# EasyEDA Pro project SMOL_ICM_NIKKI.eprj, schematic smolBrain V3.0
Board Name: smolBrainV3; Create Date: 2025-01-24; Page Name: Smol Slimes NRF by Nikki; Project Name: SMOL_ICM_NIKKI; Schematic Name: smolBrain V3.0; Update Date: 2026-02-03; Company: Des. by --nikki--; Page Size: A4; Version: V3.0
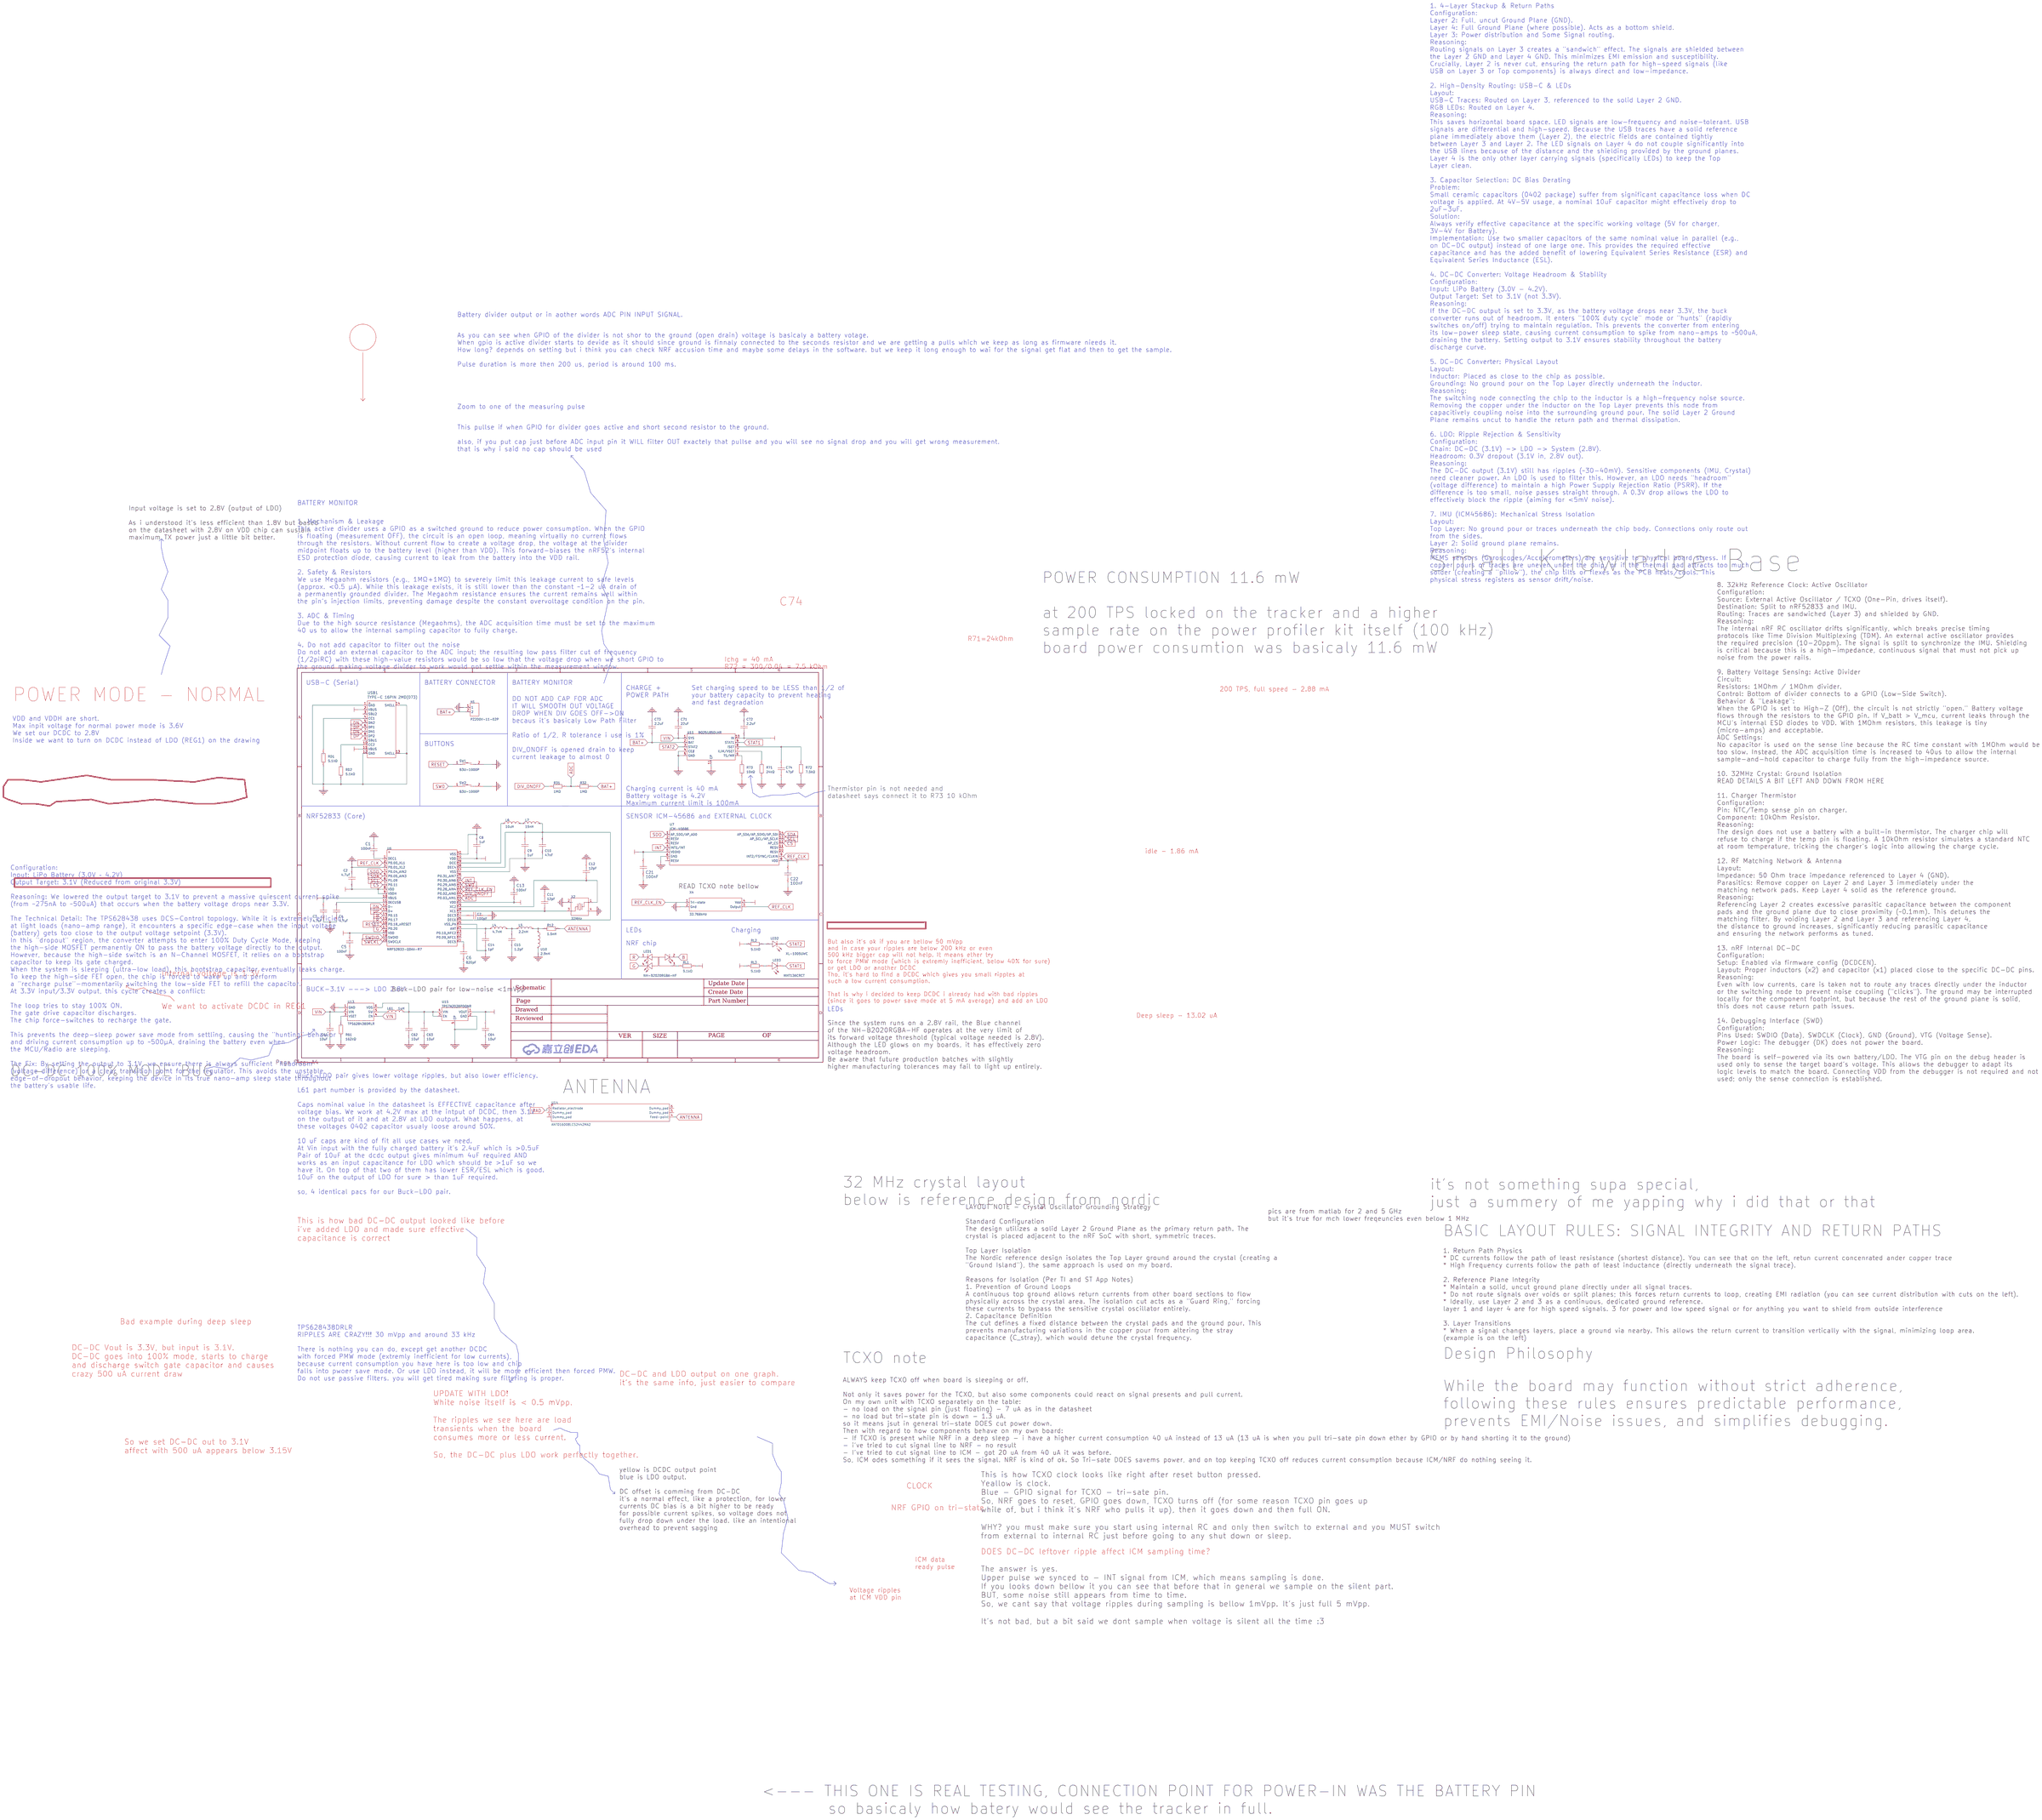
[diagram p0: schematic sheet]

## Parts
C1  100nF  [R0201]
C2  4.7uF  [C0603]
C3  4.7uF  [C0603]
C4  4.7uF  [C0402 small]
C5  100nF  [R0201]
C6  820pF  [R0201]
C7  100pF  [R0201]
C8  1uF  [C0402 small]
C9  1uF  [C0402 small]
C10  47nF  [R0201]
C11  12pF  [R0201]
C12  12pF  [R0201]
C13  100nF  [R0201]
C14  1pF  [R0201]
C15  1.2pF  [R0201]
C21  100nF  [C0201]
C22  100nF  [C0201]
C61  10uF  [C0402 small]
C62  10uF  [C0402 small]
C63  10uF  [C0402 small]
C64  10uF  [C0402 small]
C71  22uF  [C0402 small]
C72  2.2uF  [C0402 small]
C73  2.2uF  [C0402 small]
C74  47pF  [R0201]
H1  PZ200V-11-02P  [HDR-TH_2P-P2.00-V-M]  (no BOM)
L4  4.7nH  [R0201]
L5  2.2nH  [R0201]
L6  10uH  [L0603]
L7  15nH  [C0402 small]
L61  1uH  [L0806]
LED1  NH-B2020RGBA-HF  [LED-ARRAY-SMD_4P-L2.1-W2.1-TL_NH-B2020RGBA]
LED2  XL-1005UWC  [C0402 small]
LED3  MHT136CRCT  [LED0402-R-RD]
R12  1.5nH  [R0201]
R31  1MΩ  [R0201]
R32  1MΩ  [R0201]
R61  162kΩ  [R0201]
R71  24kΩ  [R0201]
R72  7.5kΩ  [R0201]
R73  10kΩ  [R0201]
RD1  5.1kΩ  [R0201]
RD2  5.1kΩ  [R0201]
RL1  5.1kΩ  [R0201]
RL2  5.1kΩ  [R0201]
RL3  5.1kΩ  [R0201]
SW1  B3U-1000P  [KEY-SMD_B3U-1000PM]
SW2  B3U-1000P  [KEY-SMD_B3U-1000PM]
U6  NRF52833-QDAA-R7  [QFN-40_L5.0-W5.0-P0.40-TL-EP3.6]
U7  ICM-45686  [LGA-14_L3.0-W2.5-P0.50-TL]
U10  2.9nH  [R0201]
U11  BQ25185DLHR  [WSON-10_L2.2-W2.0-P0.40-BL-EP_TI_DLH0010A]
U13  TPS628438DRLR  [SOT-563-6_L1.6-W1.2-P0.5-LS1.6-BR]
U14  ANT016008LCS2442MA2  [ANT-SMD_6P-L1.6-W0.8-P1.20]
U15  TPS7A2028PDQNR  [UDFN-4_L1.0-W1.0-P0.65-TL]
USB1  TYPE-C 16PIN 2MD(073)  [USB-C-SMD_TYPE-C-6PIN-2MD-073]
X2  32MHz  [CRYSTAL-SMD_4P-L1.6-W1.2-BL]
X4  32.768kHz  [OSC-SMD_4P-L3.2-W2.5-CJ13-320001210A20]

## Library data of the parts
C1 C5 C13 = GRM033C71C104KE14D: LCSC Part Name: 100nF ±10% 16V; Supplier Part: C85923; Manufacturer: muRata(村田); Supplier Footprint: 0201; JLCPCB Part Class: Extended Part; Datasheet: https://atta.szlcsc.com/upload/public/pdf/source/20200305/C490387_23319AE8C154DEB24C505E6C82A8106A.pdf; Supplier: LCSC; Tolerance: ±10%
C2 = GRM188Z71C475KE21D: LCSC Part Name: 4.7uF ±10% 16V; Supplier Part: C389010; Manufacturer: muRata(村田); Supplier Footprint: 0603; JLCPCB Part Class: Extended Part; Datasheet: https://atta.szlcsc.com/upload/public/pdf/source/20190418/C389010_378994D96815F6C3A9D8A85630794D48.pdf; Supplier: LCSC; Tolerance: ±10%
C3 = GRT188C71C475KE13D: LCSC Part Name: 4.7uF ±10% 16V; Supplier Part: C5160228; Manufacturer: muRata(村田); Supplier Footprint: 0603; JLCPCB Part Class: Extended Part; Datasheet: https://atta.szlcsc.com/upload/public/pdf/source/20220914/BD226C35220CED04E98AB01C948C26A3.pdf; Supplier: LCSC; Tolerance: ±10%
C4 = 0402X475K160NT: Capacitance:4.7uF Tolerance:±10% Tolerance:±10% Voltage Rating:16V Temperature Coefficient:X5R; LCSC Part Name: 4.7uF ±10% 16V; Supplier Part: C20624278; Manufacturer: FH(风华); Supplier Footprint: 0402; JLCPCB Part Class: Extended Part; Datasheet: https://item.szlcsc.com/datasheet/0402X475K160NT/22025173.html; Supplier: LCSC; Tolerance: ±10%; Voltage Rating: 16V; Temperature Coefficient: X5R
C6 = GRM033R71E821KA01D: LCSC Part Name: 820pF ±10% 25V; Supplier Part: C185597; Manufacturer: muRata(村田); Supplier Footprint: 0201; JLCPCB Part Class: Extended Part; Datasheet: https://atta.szlcsc.com/upload/public/pdf/source/20180612/C185597_F11A2B6CC9CF867AB82006DF342D917A.pdf; Supplier: LCSC; Tolerance: ±10%
C7 = CC0201JRNPO8BN101: LCSC Part Name: 100pF ±5% 25V; Supplier Part: C389108; Manufacturer: YAGEO(国巨); Supplier Footprint: 0201; JLCPCB Part Class: Extended Part; Datasheet: https://atta.szlcsc.com/upload/public/pdf/source/20190423/C389108_91843D0D458C7A12BC43D354921B571C.pdf; Supplier: LCSC; Tolerance: ±5%
C8 C9 = GCM155C71A105KE38D: LCSC Part Name: 1uF ±10% 10V; Supplier Part: C126521; Manufacturer: muRata(村田); Supplier Footprint: 0402; JLCPCB Part Class: Extended Part; Datasheet: https://atta.szlcsc.com/upload/public/pdf/source/20170912/C126521_1505207901642963618.pdf; Supplier: LCSC; Tolerance: ±10%
C10 = GRM033R61A473KE84D: LCSC Part Name: 47nF ±10% 10V; Supplier Part: C426098; Manufacturer: muRata(村田); Supplier Footprint: 0201; JLCPCB Part Class: Extended Part; Datasheet: https://atta.szlcsc.com/upload/public/pdf/source/20190904/C426118_85E81C7C1F21FC87C5FB6D536E0847B4.pdf; Supplier: LCSC; Tolerance: ±10%
C11 C12 = CC0201FRNPO9BN120: Capacitance: Tolerance:±1% Tolerance:±1% Voltage Rated: Temperature Coefficient:; LCSC Part Name: 12pF ±1% 50V; Supplier Part: C526929; Manufacturer: YAGEO(国巨); Supplier Footprint: 0201; JLCPCB Part Class: Extended Part; Datasheet: https://atta.szlcsc.com/upload/public/pdf/source/20200508/C526929_E3FC028A0BCFFB616642B5F941330B5D.pdf; Supplier: LCSC; Tolerance: ±1%
C14 = GJM0335C1H1R0WB01D: LCSC Part Name: ±0.05pF 1pF 50V; Supplier Part: C723324; Manufacturer: muRata(村田); Supplier Footprint: 0201; JLCPCB Part Class: Extended Part; Datasheet: https://atta.szlcsc.com/upload/public/pdf/source/20200817/C723324_D57983E1BE12F4D041CEA103E846AFB7.pdf; Supplier: LCSC
C15 = CC0201BRNPO9BN1R2: Capacitance: Voltage Rated: Temperature Coefficient:; LCSC Part Name: 1.2pF 50V ±0.1pF; Supplier Part: C326704; Manufacturer: YAGEO(国巨); Supplier Footprint: 0201; JLCPCB Part Class: Extended Part; Datasheet: https://atta.szlcsc.com/upload/public/pdf/source/20181031/C326704_E4816B1C6333835D8DA7CB97D8424EB5.pdf; Supplier: LCSC
C21 C22 = GRM033Z71C104KE14D: LCSC Part Name: 100nF ±10% 16V; Supplier Part: C668346; Manufacturer: muRata(村田); Supplier Footprint: 0201; JLCPCB Part Class: Extended Part; Datasheet: https://item.szlcsc.com/datasheet/GRM033Z71C104KE14D/698285.html; Supplier: LCSC; Tolerance: ±10%; Voltage Rating: 16V; Temperature Coefficient: X7R
C61 = GRM155R60J106ME15D: Capacitance: Tolerance:±20% Tolerance:±20% Voltage Rated: Temperature Coefficient:; LCSC Part Name: 10uF ±20% 6.3V; Supplier Part: C412251; Manufacturer: muRata(村田); Supplier Footprint: 0402; JLCPCB Part Class: Extended Part; Datasheet: https://atta.szlcsc.com/upload/public/pdf/source/20190904/C426118_85E81C7C1F21FC87C5FB6D536E0847B4.pdf; Supplier: LCSC; Tolerance: ±20%
C62-C64 = GRM155R60J106ME15D: LCSC Part Name: 10uF ±20% 6.3V; Supplier Part: C412251; Manufacturer: muRata(村田); Supplier Footprint: 0402; JLCPCB Part Class: Extended Part; Datasheet: https://atta.szlcsc.com/upload/public/pdf/source/20190904/C426118_85E81C7C1F21FC87C5FB6D536E0847B4.pdf; Supplier: LCSC; Tolerance: ±20%
C71 = GRM158R61A226ME15D: LCSC Part Name: 22uF ±20% 10V; Supplier Part: C3845593; Manufacturer: muRata(村田); Supplier Footprint: 0402; JLCPCB Part Class: Extended Part; Datasheet: https://atta.szlcsc.com/upload/public/pdf/source/20230811/016E9304DA64D47AB1EFBD6C89B0D146.pdf; Supplier: LCSC; Tolerance: ±20%
C72 C73 = GRM155R61E225KE11D: Capacitance:2.2uF Tolerance:±10% Tolerance:±10% Voltage Rating:25V Temperature Coefficient:X5R; LCSC Part Name: 2.2uF ±10% 25V; Supplier Part: C385032; Manufacturer: muRata(村田); Supplier Footprint: 0402; JLCPCB Part Class: Extended Part; Datasheet: https://item.szlcsc.com/datasheet/GRM155R61E225KE11D/358738.html; Supplier: LCSC; Tolerance: ±10%; Voltage Rating: 25V; Temperature Coefficient: X5R
C74 = GRM0335C1H470FA01D: LCSC Part Name: 47pF ±1% 50V; Supplier Part: C384993; Manufacturer: muRata(村田); Supplier Footprint: 0201; JLCPCB Part Class: Extended Part; Datasheet: https://item.szlcsc.com/datasheet/GRM0335C1H470FA01D/358699.html; Supplier: LCSC; Tolerance: ±1%; Voltage Rating: 50V; Temperature Coefficient: C0G
H1 = PZ200V-11-02P: LCSC Part Name: 1x2P 间距:2mm 方针 直插; Supplier Part: C541856; Manufacturer: XFCN(兴飞); Supplier Footprint: 插件,P=2mm; JLCPCB Part Class: Extended Part; Datasheet: https://item.szlcsc.com/datasheet/PZ200V-11-02P/562477.html; Supplier: LCSC; Pin Structure: 1x2P; Pitch: 2mm; Circluar Pins/Square Pins: Pin Header; Mounting Type: Through Hole; Number of Rows: 1; Number of Pins: 2P; Length of Mating Pin: 3.9mm; Insulation Height: 2mm; Length of End Connection Pin: 2.8mm; Contact Material: Brass; Operating Temperature: -40℃~+105℃; Color: Black
L4 = LQP03TN4N7H02D: LCSC Part Name: 4.7nH ±3%; Supplier Part: C86126; Manufacturer: muRata(村田); Supplier Footprint: 0201; JLCPCB Part Class: Extended Part; Datasheet: https://atta.szlcsc.com/upload/public/pdf/source/20200107/C157592_7FF58F85BAEF0D918ADFA12AEC0AEBA8.pdf; Supplier: LCSC; Tolerance: ±3%; Q @ Freq: 14@500MHz
L5 = LQP03TN2N2B02D: Inductance: Tolerance:- Tolerance:- Rated Current: Saturation Current (Isat):- DC Resistance (DCR): Q @ Freq:14@500MHz Frequency - Self Resonant: Ratings:; Supplier Part: C98041; Manufacturer: muRata(村田); Supplier Footprint: 0201; JLCPCB Part Class: Extended Part; Datasheet: https://atta.szlcsc.com/upload/public/pdf/source/20200107/C157592_7FF58F85BAEF0D918ADFA12AEC0AEBA8.pdf; Supplier: LCSC; Q @ Freq: 14@500MHz
L6 = MGFL1608F100MT-LF: LCSC Part Name: 10uH ±20%; Supplier Part: C281107; Manufacturer: microgate(麦捷科技); Supplier Footprint: 0603; JLCPCB Part Class: Extended Part; Datasheet: https://atta.szlcsc.com/upload/public/pdf/source/20181108/C281110_7C95BC468F539A9AC0023224EE202377.pdf; Supplier: LCSC; Tolerance: ±20%
L7 = LQG15HS15NJ02D: LCSC Part Name: 15nH ±5%; Supplier Part: C86059; Manufacturer: muRata(村田); Supplier Footprint: 0402; JLCPCB Part Class: Extended Part; Datasheet: https://atta.szlcsc.com/upload/public/pdf/source/20170810/C86059_1502335402466879997.pdf; Supplier: LCSC; Tolerance: ±5%; Q @ Freq: 8@100MHz
L61 = DFE201610E-1R0M=P2: LCSC Part Name: 1uH ±20% 3.6A; Supplier Part: C161082; Manufacturer: muRata(村田); Supplier Footprint: 0806; JLCPCB Part Class: Extended Part; Datasheet: https://atta.szlcsc.com/upload/public/pdf/source/20180329/C161082_B32C8834554668ECFD54206075068FE7.pdf; Supplier: LCSC; Tolerance: ±20%; Current Rating: 2.7A; Current - Saturation (Isat): 3.6A; DC Resistance(DCR): 57mΩ
LED1 = NH-B2020RGBA-HF: Diode Configuration:Common Anode Dominant Wavelength:G:525nm；R:622nm；B:468nm Luminous Intensity:R:45mcd；G:160mcd；B:25mcd Viewing Angle:110° Forward Current:R:8mA；G:5mA；B:3mA Forward Voltage:R:2V；G:2.7V；B:2.8V Installation Method:Positive Stick Operating T; Supplier Part: C2874116; Manufacturer: 国星光电; Supplier Footprint: SMD,2.1x2.1mm; JLCPCB Part Class: Extended Part; Datasheet: https://atta.szlcsc.com/upload/public/pdf/source/20210810/F2CC95523506BC87574AF0308E7F77A3.pdf; Supplier: LCSC; Diode Configuration: Common Anode; Dominant Wavelength: G:525nm；R:622nm；B:468nm; Luminous Intensity: R:45mcd；G:160mcd；B:25mcd; Viewing Angle: 110°; Forward Current: R:8mA；G:5mA；B:3mA; Forward Voltage: R:2V；G:2.7V；B:2.8V; Installation Method: Positive Stick; Operating Temperature: -30℃~+85℃
LED2 = XL-1005UWC_C20613596: Supplier Part: C20613596; Manufacturer: XINGLIGHT(成兴光); Supplier Footprint: 0402; JLCPCB Part Class: Extended Part; Datasheet: https://atta.szlcsc.com/upload/public/pdf/source/20221102/EACC1BAE175C81995A6088DD8BE6A010.pdf; Supplier: LCSC
LED3 = MHT136CRCT: LCSC Part Name: 红灯; Supplier Part: C397045; Manufacturer: MEIHUA(美华); Supplier Footprint: 0402; JLCPCB Part Class: Extended Part; Datasheet: https://item.szlcsc.com/datasheet/MHT136CRCT/378558.html; Supplier: LCSC; Illumination Color: Red; Voltage - Forward(Vf): 1.9V; Power(Watts): 60mW; Forward Current: 5mA; Wavelength - Dominant: 617.5nm~633.5nm; Peak Wavelength: 632nm; Lens Color: Water Clear; Luminous Intensity: 36mcd; Viewing Angle: 120°; Operating Temperature: -35℃~+85℃
R12 = LQP03TN1N5B02D: Inductance: Tolerance:- Tolerance:- Rated Current: Current - Saturation (Isat):- DC Resistance (DCR): Q @ Freq:14@500MHz Frequency - Self Resonant: Ratings:; LCSC Part Name: 1.5nH ±0.1nH; Supplier Part: C77114; Manufacturer: muRata(村田); Supplier Footprint: 0201; JLCPCB Part Class: Extended Part; Datasheet: https://atta.szlcsc.com/upload/public/pdf/source/20200107/C157592_7FF58F85BAEF0D918ADFA12AEC0AEBA8.pdf; Supplier: LCSC; Q @ Freq: 14@500MHz
R31 R32 = RC0201FR-071ML: LCSC Part Name: 厚膜电阻 1MΩ ±1% 50mW; Supplier Part: C295786; Manufacturer: YAGEO(国巨); Supplier Footprint: 0201; JLCPCB Part Class: Extended Part; Datasheet: https://item.szlcsc.com/datasheet/RC0201FR-071ML/280203.html; Supplier: LCSC; Type: Thick Film Resistor; Tolerance: ±1%; Power(Watts): 50mW; Voltage-Supply(Max): 25V; Temperature Coefficient: ±200ppm/℃; Operating Temperature: -55℃~+125℃
R61 = RC0201FR-07162KL: LCSC Part Name: 厚膜电阻 162kΩ ±1% 50mW; Supplier Part: C138172; Manufacturer: YAGEO(国巨); Supplier Footprint: 0201; JLCPCB Part Class: Extended Part; Datasheet: https://item.szlcsc.com/datasheet/RC0201FR-07162KL/149488.html; Supplier: LCSC; Type: Thick Film Resistors; Tolerance: ±1%; Power(Watts): 50mW; Voltage-Supply(Max): 25V; Temperature Coefficient: ±200ppm/℃; Operating Temperature: -55℃~+125℃
R71 = 0201WMF2402TEE: Type:Thick Film Resistor Resistance:24kΩ Tolerance:±1% Tolerance:±1% Power(Watts):50mW Voltage-Supply(Max):25V Temperature Coefficient:±200ppm/℃ Temperature Coefficient:±200ppm/℃ Operating Temperature:-55℃~+155℃ Operating Temperature:-55℃~+155℃; LCSC Part Name: 24kΩ ±1% 50mW 厚膜电阻; Supplier Part: C270353; Manufacturer: UNI-ROYAL(厚声); Supplier Footprint: 0201; JLCPCB Part Class: Extended Part; Datasheet: https://item.szlcsc.com/datasheet/0201WMF2402TEE/259883.html; Supplier: LCSC; Type: Thick Film Resistor; Tolerance: ±1%; Power(Watts): 50mW; Voltage-Supply(Max): 25V; Temperature Coefficient: ±200ppm/℃; Operating Temperature: -55℃~+155℃
R72 = 0201WMF7501TEE: Type:Thick Film Resistor Resistance:7.5kΩ Tolerance:±1% Tolerance:±1% Power(Watts):50mW Voltage-Supply(Max):25V Temperature Coefficient:±200ppm/℃ Temperature Coefficient:±200ppm/℃ Operating Temperature:-55℃~+155℃ Operating Temperature:-55℃~+155℃; LCSC Part Name: 7.5kΩ ±1% 50mW 厚膜电阻; Supplier Part: C473504; Manufacturer: UNI-ROYAL(厚声); Supplier Footprint: 0201; JLCPCB Part Class: Extended Part; Datasheet: https://item.szlcsc.com/datasheet/0201WMF7501TEE/479897.html; Supplier: LCSC; Type: Thick Film Resistor; Tolerance: ±1%; Power(Watts): 50mW; Voltage-Supply(Max): 25V; Temperature Coefficient: ±200ppm/℃; Operating Temperature: -55℃~+155℃
R73 = 0201WMF1002TEE: Type:Thick Film Resistors Resistance:10kΩ Tolerance:±1% Tolerance:±1% Power(Watts): Overload Voltage (Max): Temperature Coefficient:±200ppm/℃ Temperature Coefficient:±200ppm/℃ Operating Temperature Range:-55℃~+155℃ Operating Temperature Range:-55℃~+155℃; LCSC Part Name: 10kΩ ±1% 50mW 厚膜电阻; Supplier Part: C473048; Manufacturer: UNI-ROYAL(厚声); Supplier Footprint: 0201; JLCPCB Part Class: Extended Part; Datasheet: https://atta.szlcsc.com/upload/public/pdf/source/20200306/C422600_1E6D84923E4A46A82E41ADD87F860B5C.pdf; Supplier: LCSC; Type: Thick Film Resistors; Tolerance: ±1%; Temperature Coefficient: ±200ppm/℃; Operating Temperature Range: -55℃~+155℃
RD1 RD2 RL1-RL3 = RC0201FR-075K1L: Type:Thick Film Resistors Resistance: Tolerance:±1% Tolerance:±1% Power(Watts): Overload Voltage (Max): Temperature Coefficient:±200ppm/℃ Temperature Coefficient:±200ppm/℃ Operating Temperature Range:-55℃~+125℃ Operating Temperature Range:-55℃~+125℃; LCSC Part Name: 厚膜电阻 5.1kΩ ±1% 50mW; Supplier Part: C274341; Manufacturer: YAGEO(国巨); Supplier Footprint: 0201; JLCPCB Part Class: Extended Part; Datasheet: https://atta.szlcsc.com/upload/public/pdf/source/20180821/C275644_0D56F95EFF785E7D9A1FEF436B37DA78.pdf; Supplier: LCSC; Type: Thick Film Resistors; Tolerance: ±1%; Temperature Coefficient: ±200ppm/℃; Operating Temperature Range: -55℃~+125℃
SW1 SW2 = B3U-1000P_C231329: LCSC Part Name: 3*2.5*1.6mm 立贴 轻触开关; Supplier Part: C231329; Manufacturer: OMRON(欧姆龙); Supplier Footprint: SMD,2.5x3mm; JLCPCB Part Class: Extended Part; Datasheet: https://item.szlcsc.com/datasheet/B3U-1000P/231216.html; Supplier: LCSC; Circuit: SPST; Actuator Style: Round Button; Operating Force: 1.53N; Mounting Type: Surface Mount,Vertical; Length: 3mm; Width: 2.5mm; Switch Height: 1.6mm; Contact Current: 50mA; Voltage Rating: 12V; Termination Style: SMD(SMT) Tab; Operating Temperature: -25℃~+70℃
U6 = NRF52833-QDAA-R7: Supplier Part: C3007767; Manufacturer: NORDIC; Supplier Footprint: QFN-40-EP(5x5); JLCPCB Part Class: Extended Part; Datasheet: https://atta.szlcsc.com/upload/public/pdf/source/20220425/813B94CC02EC3880014CD9D5C0131E63.pdf; Supplier: LCSC; Frequency Range: 2.4GHz; Interface: ADC,I2S,PWM,SPI,UART,USB; Operating Voltage: 1.7V~5.5V; Applications: 802.15.4,蓝牙; Output Power: 8dBm; Data Rate: 2Mbps; Current Of Transmitting: 2.3mA; Sensitivity: -103dBm; Receive Current: 3.4mA; Operating Temperature: -40℃~+105℃
U7 = ICM-45686: Supplier Part: C22459454; Manufacturer: TDK InvenSense(应美盛); Supplier Footprint: LGA-14(3x2.5); JLCPCB Part Class: Extended Part; Datasheet: https://item.szlcsc.com/datasheet/ICM-45686/24135842.html; Supplier: LCSC
U10 = LQP03TN2N9B02D: Inductance: Tolerance:- Tolerance:- Rated Current: Current - Saturation (Isat):- DC Resistance (DCR): Q @ Freq:14@500MHz Frequency - Self Resonant: Ratings: Type:Thick Film Inductor; LCSC Part Name: 2.9nH ±0.1nH; Supplier Part: C206431; Manufacturer: muRata(村田); Supplier Footprint: 0201; JLCPCB Part Class: Extended Part; Datasheet: https://atta.szlcsc.com/upload/public/pdf/source/20200107/C157592_7FF58F85BAEF0D918ADFA12AEC0AEBA8.pdf; Supplier: LCSC; Q @ Freq: 14@500MHz; Type: Thick Film Inductor
U11 = BQ25185DLHR: Supplier Part: C19725033; Manufacturer: TI(德州仪器); Supplier Footprint: WSON-10-EP(2.2x2); JLCPCB Part Class: Extended Part; Datasheet: https://www.ti.com.cn/cn/lit/ds/symlink/bq25185.pdf?ts=1739415017761&ref_url=https%253A%252F%252Fwww.ti.com.cn%252Fproduct%252Fcn%252FBQ25185%253FkeyMatch%253Dbq25185%2526tisearch%253Duniversal_search; Supplier: LCSC
U13 = TPS628438DRLR: LCSC Part Name: 1.8V至5.5V、600mA、275nA Iq小型降压转换器; Supplier Part: C38060243; Manufacturer: TI(德州仪器); Supplier Footprint: SOT-563; JLCPCB Part Class: Extended Part; Datasheet: https://www.ti.com.cn/cn/lit/gpn/TPS62843; Supplier: LCSC; Output Type: Adjustable; Voltage - Supply: 5.5V; Output Voltage: 1.8V~3.6V; Output Current: 600mA; standby current: 275nA; Features: Soft Start；Enable；Over Current Protection；Under Voltage Lockout；Over Temperature Protection; Operating Temperature: -40℃~+125℃; Output Configuration: Positive; Number of Outputs: 1
U14 = ANT016008LCS2442MA2: Supplier Part: C209892; Manufacturer: TDK; Supplier Footprint: SMD-6P,1.6x0.8mm; JLCPCB Part Class: Extended Part; Datasheet: https://item.szlcsc.com/datasheet/ANT016008LCS2442MA2/210943.html; Supplier: LCSC; Antenna Type: 2.4G Antenna; Frequency(Center/Band): 2.442GHz; Bandwidth: 84MHz; Peak Gain: 2.5dBi; Impedance: 50Ω; Power: 800mW; VSWR: 3; Operating Temperature: -40℃~+85℃; Length: 1.6mm; Width: 0.8mm; Height: 0.4mm
U15 = TPS7A2028PDQNR: LCSC Part Name: 具有高 PSRR 的 300mA、超低噪声、低 IQ、低压降 (LDO) 线性稳压器; Supplier Part: C2873380; Manufacturer: TI(德州仪器); Supplier Footprint: X2-SON-4-EP(1x1); JLCPCB Part Class: Extended Part; Datasheet: http://www.ti.com/cn/lit/gpn/tps7a20; Supplier: LCSC; Output Type: Fixed; Maximum Input Voltage: 6V; Output Voltage: 2.8V; Output Current: 300mA; Power Supply Rejection Ratio (PSRR): 60dB@(100Hz); Feature: ESD Protection；Soft Start；Surge Protection；Low ESR；Thermal Protection(TSD)；Under-voltage Lockout；Overcurrent Protection(OCP)；With ability；Anti-Siphon; Operating Temperature: -40℃~+125℃@(Tj); Output Polarity: Positive electrode; Number of Outputs: 1
USB1 = TYPE-C 16PIN 2MD(073): Connector Type:Type-C Standard:USB 3.1 Gender:Female Mounting Style:Horizontal attachment Number of Contacts:16P Number of Ports:1 Current Rating - Power (Max):5A Operating Temperature Range:-25℃~+85℃ Operating Temperature Range:-25℃~+85℃ Rated Voltage (M; LCSC Part Name: Type-C 母 卧贴; Supplier Part: C2765186; Manufacturer: SHOU HAN(首韩); Supplier Footprint: SMD; JLCPCB Part Class: Extended Part; Datasheet: https://atta.szlcsc.com/upload/public/pdf/source/20211123/39B17C16241EAC15C5E277BDA434118E.pdf; Supplier: LCSC; Connector Type: Type-C; Standard: USB 3.1; Gender: Female; Mounting Style: Horizontal attachment; Number of Contacts: 16P; Number of Ports: 1; Current Rating - Power (Max): 5A; Operating Temperature Range: -25℃~+85℃; Rated Voltage (Max): 5V; Connect-Disconnect Life: 5000 Cuts; Core Colour: Black
X2 = X161232MKB4SI: LCSC Part Name: 32MHz ±10ppm 8pF; Supplier Part: C2982342; Manufacturer: YXC(扬兴晶振); Supplier Footprint: SMD1612-4P; JLCPCB Part Class: Extended Part; Datasheet: https://atta.szlcsc.com/upload/public/pdf/source/20240329/D9025446BDBD7B39CDD0BF685E81FE1D.pdf; Supplier: LCSC; Type: Surface Mount Crystal; Normal temperature Frequency Tolerance: ±10ppm; Load Capacitance: 8pF; Frequency Stability: ±30ppm; Operating Temperature: -40℃~+85℃
X4 = SX3M32.768KB10F20TLN: LCSC Part Name: 32.768KHz 3.3V ±20ppm 低功耗; Supplier Part: C21547575; Manufacturer: SCTF(星通时频); Supplier Footprint: SMD3225-4P; JLCPCB Part Class: Extended Part; Datasheet: https://atta.szlcsc.com/upload/public/pdf/source/20240516/01911A10C656070D41FFDDFD2030633A.pdf; Supplier: LCSC; Normal temperature Frequency Tolerance: ±10ppm; Output Type: CMOS; Voltage - Supply: 3.3V; Current - Supply: 7.2uA; Frequency Stability: ±20ppm; Operating Temperature: -40℃~+85℃

## Nets
2V8: C2.2 C5.2 C8.1 C13.1 C21.2 C22.2 C64.1 RL1.1 U6.8(VDD) U6.9(VDDH) U6.18(VDD) U6.30(VDD) U6.40(VDD) U7.5(VDDIO) U7.8(VDD) U15.1(VOUT) X4.4(Vdd)
+5V: C3.2 C72.1 RL2.2 RL3.2 U6.10(VBUS) U11.10(IN) USB1.2(VBUS) USB1.11(VBUS)
GND: C1.2 C2.1 C3.1 C4.1 C5.1 C6.1 C7.1 C8.2 C9.1 C10.1 C11.2 C12.2 C13.2 C14.1 C15.1 C21.1 C22.1 C61.1 C62.2 C63.2 C64.2 C71.2 C72.2 C73.1 C74.1 H1.1 R61.1 R71.1 R72.1 R73.1 RD1.1 RD2.1 SW1.2 SW2.2 U6.3(P0.01_XL2) U6.25(VSS_PA) U6.37(VSS) U6.41(VSS) U7.6(GND) U10.2 U11.4(CE#) U11.5(GND) U11.11(EP) U13.1(GND) U15.2(GND) U15.5(EP) USB1.1(GND) USB1.12(GND) USB1.13(SHELL) USB1.14(SHELL) X2.2(GND) X2.4(GND) X4.2(Gnd)
VIN: C61.2 C71.1 U11.1(SYS) U13.2(VIN) U13.4(EN)
ADC: R31.2 R32.1 U6.31(P0.03_AIN1)
ANTENNA: R12.2 U14.4(Feed-point)
B: LED1.2(-) U6.14(P0.15)
BAT+: C73.2 H1.2 R32.2 U11.2(BAT)
CS: U6.7(P0.11) U7.12(AP_CS)
DIV_ONOFF: R31.1 U6.32(P0.02_AIN0)
DN: U6.12(D-) USB1.5(DN2) USB1.7(DN1)
DP: U6.13(D+) USB1.6(DP1) USB1.8(DP2)
G: LED1.4(-) U6.17(P0.20)
INT: U6.35(P0.30_AIN6) U7.4(INT1/INT)
R: LED1.1(-) U6.15(P0.17)
RAD: U14.1(Radiator_electrode)
REF_CLK: U6.2(P0.00_XL1) U7.9(INT2/FSYNC/CLKIN) X4.3(Output)
REF_CLK_EN: U6.33(P0.28_AIN4) X4.1(Tri-state)
RESET: SW1.1 U6.16(P0.18_nRESET)
SCL: U6.6(P1.09) U7.13(AP_SCL/AP_SCLK)
SDA: U6.5(P0.05_AIN3) U7.14(AP_SDA/AP_SDIO/AP_SDI)
SDO: U6.4(P0.04_AIN2) U7.1(AP_SDO/AP_AD0)
STAT1: LED3.2(K) U11.9(STAT1)
STAT2: LED2.1(K) U11.3(STAT2)
SW0: SW2.1 U6.34(P0.29_AIN5)
SWCKL: U6.20(SWDCLK)
SWDIO: U6.19(SWDIO)
$1N2030: RD1.2 USB1.4(CC1)
$1N2031: RD2.2 USB1.10(CC2)
$1N108586: C11.1 U6.28(XC1) X2.3
$1N109017: C4.2 U6.11(DECUSB)
$1N109226: C15.2 L4.2 L5.1
$1N109724: C14.2 L4.1 U6.24(ANT)
$1N109749: C7.2 U6.27(DEC3)
$1N110127: C9.2 C10.2 L7.2 U6.26(DEC6) U6.38(DEC4)
$1N110150: L6.1 U6.39(DCC)
$1N110162: C1.1 U6.1(DEC1)
$1N110177: C6.2 U6.21(DEC5)
$1N127138: L6.2 L7.1
$1N127322: C12.1 U6.29(XC2) X2.1
$1N127455: LED1.3(+) RL1.2
$1N134854: L5.2 R12.1 U10.1
$1N141272: R71.2 U11.7(ILIM/VSET)
$1N141329: C74.2 R72.2 U11.8(ISET)
$1N146947: C62.1 C63.1 L61.2 U13.6(VOS) U15.3(EN) U15.4(VIN)
$1N146997: L61.1 U13.5(SW)
$1N151523: LED2.2(A) RL2.1
$1N151616: LED3.1(A) RL3.1
$1N181655: R73.2 U11.6(TS/MR)
$1N203824: R61.2 U13.3(VSET)

Not connected (* = marked no-connect by the designer): U6 22(P0.09_NFC1) 23(P0.10_NFC2) 36(P0.31_AIN7); U7 2(RESV) 3(RESV) 7(RESV) 10(RESV) 11(RESV); U14 2(Dummy_pad) 3(Dummy_pad) 5(Dummy_pad) 6(Dummy_pad); USB1 3(SBU2) 9(SBU1)

## Notes on the sheet
- Battery divider output or in aother words ADC PIN INPUT SIGNAL.
- As you can see when GPIO of the divider is not shor to the ground (open drain) voltage is basicaly a battery votage.
  When gpio is active divider starts to devide as it should since ground is finnaly connected to the seconds resistor and we are getting a pulls which we keep as long as firmware nieeds it.
  How long? depends on setting but i think you can check NRF accusion time and maybe some delays in the software. but we keep it long enough to wai for the signal get flat and then to get the sample.
  Pulse duration is more then 200 us, period is around 100 ms.
- Zoom to one of the measuring pulse
- This pullse if when GPIO for divider goes active and short second resistor to the ground.
  also, if you put cap just before ADC input pin it WILL filter OUT exactely that pullse and you will see no signal drop and you will get wrong measurement.
  that is why i said no cap should be used
- Input voltage is set to 2.8V (output of LDO)
  As i understood it's less efficient than 1.8V but based
  on the datasheet with 2.8V on VDD chip can sustain
  maximum TX power just a little bit better.
- BATTERY MONITOR
- 1. Mechanism & Leakage
  This active divider uses a GPIO as a switched ground to reduce power consumption. When the GPIO
  is floating (measurement OFF), the circuit is an open loop, meaning virtually no current flows
  through the resistors. Without current flow to create a voltage drop, the voltage at the divider
  midpoint floats up to the battery level (higher than VDD). This forward-biases the nRF52's internal
  ESD protection diode, causing current to leak from the battery into the VDD rail.
  2. Safety & Resistors
  We use Megaohm resistors (e.g., 1MΩ+1MΩ) to severely limit this leakage current to safe levels
  (approx. <0.5 µA). While this leakage exists, it is still lower than the constant ~1-2 uA drain of
  a permanently grounded divider. The Megaohm resistance ensures the current remains well within
  the pin's injection limits, preventing damage despite the constant overvoltage condition on the pin.
  3. ADC & Timing
  Due to the high source resistance (Megaohms), the ADC acquisition time must be set to the maximum
  40 us to allow the internal sampling capacitor to fully charge.
  4. Do not add capacitor to filter out the noise
  Do not add an external capacitor to the ADC input; the resulting low pass filter cut of frequency
  (1/2piRC) with these high-value resistors would be so low that the voltage drop when we short GPIO to
  the ground making voltage divider to work would not settle within the measurement window.
- POWER CONSUMPTION 11.6 mW
  at 200 TPS locked on the tracker and a higher
  sample rate on the power profiler kit itself (100 kHz)
  board power consumtion was basicaly 11.6 mW
- Small Knowledge Base
- 1. 4-Layer Stackup & Return Paths
  Configuration:
  Layer 2: Full, uncut Ground Plane (GND).
  Layer 4: Full Ground Plane (where possible). Acts as a bottom shield.
  Layer 3: Power distribution and Some Signal routing.
  Reasoning:
  Routing signals on Layer 3 creates a "sandwich" effect. The signals are shielded between
  the Layer 2 GND and Layer 4 GND. This minimizes EMI emission and susceptibility.
  Crucially, Layer 2 is never cut, ensuring the return path for high-speed signals (like
  USB on Layer 3 or Top components) is always direct and low-impedance.
  2. High-Density Routing: USB-C & LEDs
  Layout:
  USB-C Traces: Routed on Layer 3, referenced to the solid Layer 2 GND.
  RGB LEDs: Routed on Layer 4.
  Reasoning:
  This saves horizontal board space. LED signals are low-frequency and noise-tolerant. USB
  signals are differential and high-speed. Because the USB traces have a solid reference
  plane immediately above them (Layer 2), the electric fields are contained tightly
  between Layer 3 and Layer 2. The LED signals on Layer 4 do not couple significantly into
  the USB lines because of the distance and the shielding provided by the ground planes.
  Layer 4 is the only other layer carrying signals (specifically LEDs) to keep the Top
  Layer clean.
  3. Capacitor Selection: DC Bias Derating
  Problem:
  Small ceramic capacitors (0402 package) suffer from significant capacitance loss when DC
  voltage is applied. At 4V-5V usage, a nominal 10uF capacitor might effectively drop to
  2uF-3uF.
  Solution:
  Always verify effective capacitance at the specific working voltage (5V for charger,
  3V-4V for Battery).
  Implementation: Use two smaller capacitors of the same nominal value in parallel (e.g.,
  on DC-DC output) instead of one large one. This provides the required effective
  capacitance and has the added benefit of lowering Equivalent Series Resistance (ESR) and
  Equivalent Series Inductance (ESL).
  4. DC-DC Converter: Voltage Headroom & Stability
  Configuration:
  Input: LiPo Battery (3.0V - 4.2V).
  Output Target: Set to 3.1V (not 3.3V).
  Reasoning:
  If the DC-DC output is set to 3.3V, as the battery voltage drops near 3.3V, the buck
  converter runs out of headroom. It enters "100% duty cycle" mode or "hunts" (rapidly
  switches on/off) trying to maintain regulation. This prevents the converter from entering
  its low-power sleep state, causing current consumption to spike from nano-amps to ~500uA,
  draining the battery. Setting output to 3.1V ensures stability throughout the battery
  discharge curve.
  5. DC-DC Converter: Physical Layout
  Layout:
  Inductor: Placed as close to the chip as possible.
  Grounding: No ground pour on the Top Layer directly underneath the inductor.
  Reasoning:
  The switching node connecting the chip to the inductor is a high-frequency noise source.
  Removing the copper under the inductor on the Top Layer prevents this node from
  capacitively coupling noise into the surrounding ground pour. The solid Layer 2 Ground
  Plane remains uncut to handle the return path and thermal dissipation.
  6. LDO: Ripple Rejection & Sensitivity
  Configuration:
  Chain: DC-DC (3.1V) -> LDO -> System (2.8V).
  Headroom: 0.3V dropout (3.1V in, 2.8V out).
  Reasoning:
  The DC-DC output (3.1V) still has ripples (~30-40mV). Sensitive components (IMU, Crystal)
  need cleaner power. An LDO is used to filter this. However, an LDO needs "headroom"
  (voltage difference) to maintain a high Power Supply Rejection Ratio (PSRR). If the
  difference is too small, noise passes straight through. A 0.3V drop allows the LDO to
  effectively block the ripple (aiming for <5mV noise).
  7. IMU (ICM45686): Mechanical Stress Isolation
  Layout:
  Top Layer: No ground pour or traces underneath the chip body. Connections only route out
  from the sides.
  Layer 2: Solid ground plane remains.
  Reasoning:
  MEMS sensors (Gyroscopes/Accelerometers) are sensitive to physical board stress. If
  copper pours or traces are uneven under the chip, or if the thermal pad attracts too much
  solder (creating a "pillow"), the chip tilts or flexes as the PCB heats/cools. This
  physical stress registers as sensor drift/noise.
- 8. 32kHz Reference Clock: Active Oscillator
  Configuration:
  Source: External Active Oscillator / TCXO (One-Pin, drives itself).
  Destination: Split to nRF52833 and IMU.
  Routing: Traces are sandwiched (Layer 3) and shielded by GND.
  Reasoning:
  The internal nRF RC oscillator drifts significantly, which breaks precise timing
  protocols like Time Division Multiplexing (TDM). An external active oscillator provides
  the required precision (10-20ppm). The signal is split to synchronize the IMU. Shielding
  is critical because this is a high-impedance, continuous signal that must not pick up
  noise from the power rails.
  9. Battery Voltage Sensing: Active Divider
  Circuit:
  Resistors: 1MOhm / 1MOhm divider.
  Control: Bottom of divider connects to a GPIO (Low-Side Switch).
  Behavior & "Leakage":
  When the GPIO is set to High-Z (Off), the circuit is not strictly "open." Battery voltage
  flows through the resistors to the GPIO pin. If V_batt > V_mcu, current leaks through the
  MCU's internal ESD diodes to VDD. With 1MOhm resistors, this leakage is tiny
  (micro-amps) and acceptable.
  ADC Settings:
  No capacitor is used on the sense line because the RC time constant with 1MOhm would be
  too slow. Instead, the ADC acquisition time is increased to 40us to allow the internal
  sample-and-hold capacitor to charge fully from the high-impedance source.
  10. 32MHz Crystal: Ground Isolation
  READ DETAILS A BIT LEFT AND DOWN FROM HERE
  11. Charger Thermistor
  Configuration:
  Pin: NTC/Temp sense pin on charger.
  Component: 10kOhm Resistor.
  Reasoning:
  The design does not use a battery with a built-in thermistor. The charger chip will
  refuse to charge if the temp pin is floating. A 10kOhm resistor simulates a standard NTC
  at room temperature, tricking the charger's logic into allowing the charge cycle.
  12. RF Matching Network & Antenna
  Layout:
  Impedance: 50 Ohm trace impedance referenced to Layer 4 (GND).
  Parasitics: Remove copper on Layer 2 and Layer 3 immediately under the
  matching network pads. Keep Layer 4 solid as the reference ground.
  Reasoning:
  Referencing Layer 2 creates excessive parasitic capacitance between the component
  pads and the ground plane due to close proximity (~0.1mm). This detunes the
  matching filter. By voiding Layer 2 and Layer 3 and referencing Layer 4,
  the distance to ground increases, significantly reducing parasitic capacitance
  and ensuring the network performs as tuned.
  13. nRF Internal DC-DC
  Configuration:
  Setup: Enabled via firmware config (DCDCEN).
  Layout: Proper inductors (x2) and capacitor (x1) placed close to the specific DC-DC pins.
  Reasoning:
  Even with low currents, care is taken not to route any traces directly under the inductor
  or the switching node to prevent noise coupling ("clicks"). The ground may be interrupted
  locally for the component footprint, but because the rest of the ground plane is solid,
  this does not cause return path issues.
  14. Debugging Interface (SWD)
  Configuration:
  Pins Used: SWDIO (Data), SWDCLK (Clock), GND (Ground), VTG (Voltage Sense).
  Power Logic: The debugger (DK) does not power the board.
  Reasoning:
  The board is self-powered via its own battery/LDO. The VTG pin on the debug header is
  used only to sense the target board's voltage. This allows the debugger to adapt its
  logic levels to match the board. Connecting VDD from the debugger is not required and not
  used; only the sense connection is established.
- C74
- R71=24kOhm
- Ichg = 40 mA
  R72 = 300/0.04 = 7.5 kOhm
- USB-C (Serial)
- BATTERY CONNECTOR
- BATTERY MONITOR
- CHARGE +
  POWER PATH
- Set charging speed to be LESS than 1/2 of
  your battery capacity to prevent heating
  and fast degradation
- 200 TPS, full speed - 2.88 mA
- DO NOT ADD CAP FOR ADC
  IT WILL SMOOTH OUT VOLTAGE
  DROP WHEN DIV GOES OFF->ON
  becaus it's basicaly Low Path Filter
  Ratio of 1/2, R tolerance i use is 1%
  DIV_ONOFF is opened drain to keep
  current leakage to almost 0
- POWER MODE - NORMAL
- VDD and VDDH are short.
  Max inpit voltage for normal power mode is 3.6V
  We set our DCDC to 2.8V
  Inside we want to turn on DCDC instead of LDO (REG1) on the drawing
- BUTTONS
- Charging current is 40 mA
  Battery voltage is 4.2V
  Maximum current limit is 100mA
- Thermistor pin is not needed and
  datasheet says connect it to R73 10 kOhm
- NRF52833 (Core)
- SENSOR ICM-45686 and EXTERNAL CLOCK
- idle - 1.86 mA
- READ TCXO note bellow
- LEDs
- Charging
- But also it's ok if you are bellow 50 mVpp
  and in case your ripples are below 200 kHz or even
  500 kHz bigger cap will not help. It means ether try
  to force PMW mode (which is extremly inefficient, below 40% for sure)
  or get LDO or another DCDC
  Tho, it's hard to find a DCDC which gives you small ripples at
  such a low current consumption.
  That is why i decided to keep DCDC i already had with bad ripples
  (since it goes to power save mode at 5 mA average) and add an LDO
- NRF chip
- Internal voltage is 1.3V
- BUCK-3.1V ---> LDO 2.8V
- Buck-LDO pair for low-noise <1mVpp
- We want to activate DCDC in REG1
- LEDs
- Deep sleep - 13.02 uA
- Since the system runs on a 2.8V rail, the Blue channel
  of the NH-B2020RGBA-HF operates at the very limit of
  its forward voltage threshold (typical voltage needed is 2.8V).
  Although the LED glows on my boards, it has effectively zero
  voltage headroom.
  Be aware that future production batches with slightly
  higher manufacturing tolerances may fail to light up entirely.
- Buck-LDO pair gives lower voltage ripples, but also lower efficiency.
  L61 part number is provided by the datasheet.
  Caps nominal value in the datasheet is EFFECTIVE capacitance after
  voltage bias. We work at 4.2V max at the intput of DCDC, then 3.1V
  on the output of it and at 2.8V at LDO output. What happens, at
  these voltages 0402 capacitor usualy loose around 50%.
  10 uF caps are kind of fit all use cases we need.
  At Vin input with the fully charged battery it's 2.4uF which is >0.5uF
  Pair of 10uF at the dcdc output gives minimum 4uF required AND
  works as an input capacitance for LDO which should be >1uF so we
  have it. On top of that two of them has lower ESR/ESL which is good.
  10uF on the output of LDO for sure > than 1uF required.
  so, 4 identical pacs for our Buck-LDO pair.
- DC-DC 100% MODE BUG
- Configuration:
  Input: LiPo Battery (3.0V – 4.2V)
  Output Target: 3.1V (Reduced from original 3.3V)
  Reasoning: We lowered the output target to 3.1V to prevent a massive quiescent current spike
  (from ~275nA to ~500uA) that occurs when the battery voltage drops near 3.3V.
  The Technical Detail: The TPS628438 uses DCS-Control topology. While it is extremely efficient
  at light loads (nano-amp range), it encounters a specific edge-case when the input voltage
  (battery) gets too close to the output voltage setpoint (3.3V).
  In this "dropout" region, the converter attempts to enter 100% Duty Cycle Mode, keeping
  the high-side MOSFET permanently ON to pass the battery voltage directly to the output.
  However, because the high-side switch is an N-Channel MOSFET, it relies on a bootstrap
  capacitor to keep its gate charged.
  When the system is sleeping (ultra-low load), this bootstrap capacitor eventually leaks charge.
  To keep the high-side FET open, the chip is forced to wake up and perform
  a "recharge pulse"-momentarily switching the low-side FET to refill the capacitor.
  At 3.3V input/3.3V output, this cycle creates a conflict:
  The loop tries to stay 100% ON.
  The gate drive capacitor discharges.
  The chip force-switches to recharge the gate.
  This prevents the deep-sleep power save mode from settling, causing the "hunting" behavior
  and driving current consumption up to ~500µA, draining the battery even when
  the MCU/Radio are sleeping.
  The Fix: By setting the output to 3.1V, we ensure there is always sufficient "headroom"
  (voltage difference) or a clear transition point for the regulator. This avoids the unstable
  edge-of-dropout behavior, keeping the device in its true nano-amp sleep state throughout
  the battery's usable life.
- ANTENNA
- 32 MHz crystal layout
  below is reference design from nordic
- it's not something supa special,
  just a summery of me yapping why i did that or that
- LAYOUT NOTE - Crystal Oscillator Grounding Strategy
  Standard Configuration
  The design utilizes a solid Layer 2 Ground Plane as the primary return path. The
  crystal is placed adjacent to the nRF SoC with short, symmetric traces.
  Top Layer Isolation
  The Nordic reference design isolates the Top Layer ground around the crystal (creating a
  "Ground Island"), the same approach is used on my board.
  Reasons for Isolation (Per TI and ST App Notes)
  1. Prevention of Ground Loops
  A continuous top ground allows return currents from other board sections to flow
  physically across the crystal area. The isolation cut acts as a "Guard Ring," forcing
  these currents to bypass the sensitive crystal oscillator entirely.
  2. Capacitance Definition
  The cut defines a fixed distance between the crystal pads and the ground pour. This
  prevents manufacturing variations in the copper pour from altering the stray
  capacitance (C_stray), which would detune the crystal frequency.
- pics are from matlab for 2 and 5 GHz
  but it's true for mch lower freqeuncies even below 1 MHz
- This is how bad DC-DC output looked like before
  i've added LDO and made sure effective
  capacitance is correct
- BASIC LAYOUT RULES: SIGNAL INTEGRITY AND RETURN PATHS
- 1. Return Path Physics
  * DC currents follow the path of least resistance (shortest distance). You can see that on the left, retun current concenrated ander copper trace
  * High Frequency currents follow the path of least inductance (directly underneath the signal trace).
  2. Reference Plane Integrity
  * Maintain a solid, uncut ground plane directly under all signal traces.
  * Do not route signals over voids or split planes; this forces return currents to loop, creating EMI radiation (you can see current distribution with cuts on the left).
  * Ideally, use Layer 2 and 3 as a continuous, dedicated ground reference.
  layer 1 and layer 4 are for high speed signals. 3 for power and low speed signal or for anything you want to shield from outside interference
  3. Layer Transitions
  * When a signal changes layers, place a ground via nearby. This allows the return current to transition vertically with the signal, minimizing loop area.
  (example is on the left)
- Bad example during deep sleep
- TPS628438DRLR
  RIPPLES ARE CRAZY!!! 30 mVpp and around 33 kHz
  There is nothing you can do, except get another DCDC
  with forced PMW mode (extremly inefficient for low currents),
  because current consumption you have here is too low and chip
  falls into pwoer save mode. Or use LDO instead, it will be more efficient then forced PMW.
  Do not use passive filters. you will get tired making sure filtering is proper.
- DC-DC Vout is 3.3V, but input is 3.1V.
  DC-DC goes into 100% mode, starts to charge
  and discharge switch gate capacitor and causes
  crazy 500 uA current draw
- Design Philosophy
- TCXO note
- DC-DC and LDO output on one graph.
  it's the same info, just easier to compare
- ALWAYS keep TCXO off when board is sleeping or off.
  Not only it saves power for the TCXO, but also some components could react on signal presents and pull current.
  On my own unit with TCXO separately on the table:
  - no load on the signal pin (just floating) - 7 uA as in the datasheet
  - no load but tri-state pin is down - 1.3 uA.
  so it means jsut in general tri-state DOES cut power down.
  Then with regard to how components behave on my own board:
  - If TCXO is present while NRF in a deep sleep - i have a higher current consumption 40 uA instead of 13 uA (13 uA is when you pull tri-sate pin down ether by GPIO or by hand shorting it to the ground)
  - i've tried to cut signal line to NRF - no result
  - I've tried to cut signal line to ICM - got 20 uA from 40 uA it was before.
  So, ICM odes something if it sees the signal. NRF is kind of ok. So Tri-sate DOES savems power, and on top keeping TCXO off reduces current consumption because ICM/NRF do nothing seeing it.
- While the board may function without strict adherence,
  following these rules ensures predictable performance,
  prevents EMI/Noise issues, and simplifies debugging.
- UPDATE WITH LDO!
  White noise itself is < 0.5 mVpp.
  The ripples we see here are load
  transients when the board
  consumes more or less current.
  So, the DC-DC plus LDO work perfectly together.
- So we set DC-DC out to 3.1V
  affect with 500 uA appears below 3.15V
- yellow is DCDC output point
  blue is LDO output.
  DC offset is comming from DC-DC
  it's a normal effect, like a protection, for lower
  currents DC bias is a bit higher to be ready
  for possible current spikes, so voltage does not
  fully drop down under the load. like an intentional
  overhead to prevent sagging
- This is how TCXO clock looks like right after reset button pressed.
  Yeallow is clock.
  Blue - GPIO signal for TCXO - tri-sate pin.
  So, NRF goes to reset, GPIO goes down, TCXO turns off (for some reason TCXO pin goes up
  while of, but i think it's NRF who pulls it up), then it goes down and then full ON.
  WHY? you must make sure you start using internal RC and only then switch to external and you MUST switch
  from external to internal RC just before going to any shut down or sleep.
- CLOCK
- NRF GPIO on tri-state
- DOES DC-DC leftover ripple affect ICM sampling time?
- ICM data
  ready pulse
- The answer is yes.
  Upper pulse we synced to - INT signal from ICM, which means sampling is done.
  If you looks down bellow it you can see that before that in general we sample on the silent part.
  BUT, some noise still appears from time to time.
  So, we cant say that voltage ripples during sampling is bellow 1mVpp. It's just full 5 mVpp.
  It's not bad, but a bit said we dont sample when voltage is silent all the time :3
- Voltage ripples
  at ICM VDD pin
- <--- THIS ONE IS REAL TESTING, CONNECTION POINT FOR POWER-IN WAS THE BATTERY PIN
          so basicaly how batery would see the tracker in full.
